# Altium schematic sheet MAZ000152 - Diagrama físico.SchDoc: MAZ000152 - Diagrama físico
size A; ApprovedBy: Christian Ledwidth; CheckedBy: Nahuel Martinez; Author: Santiago Marti; CompanyName: Body Health; DrawnBy: Santiago Marti; Revision: A; SheetNumber: 2; SheetTotal: 2
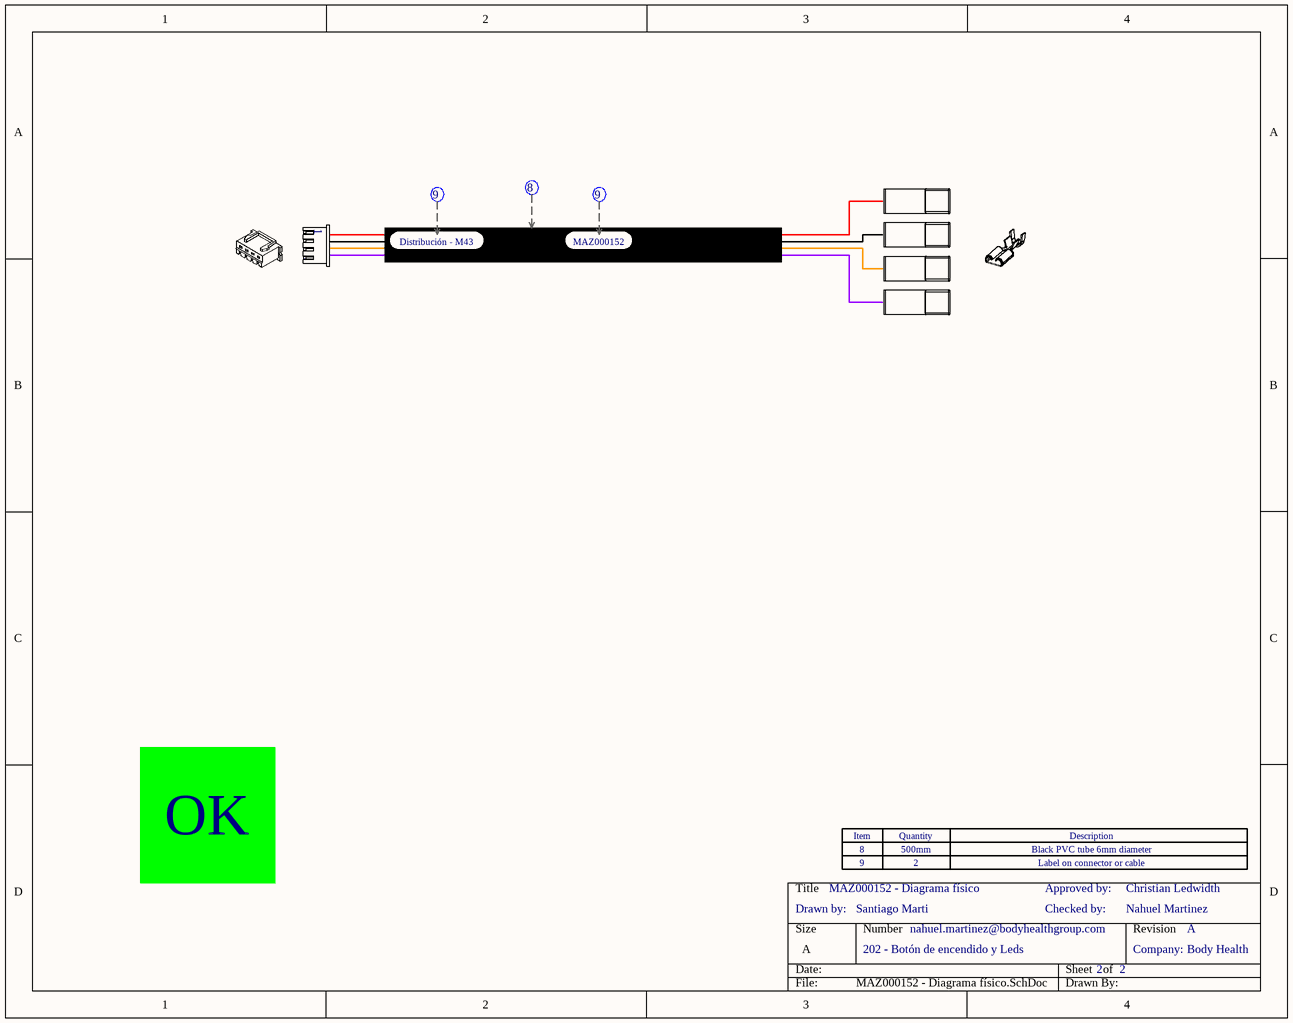
[diagram p0: MAZ000152 - Diagrama físico.SchDoc]

## Parts
(Parts that share a designator on the sheet are numbered #1, #2 ... from top to bottom, then left to right.)
Con?#1  Shovel  (value not drawn)  (part A of 4)
Con?#2  Shovel  (value not drawn)  (part A of 4)
Con?#3  XHP-4  (value not drawn)  (part A of 4)
Con?#4  Shovel  (value not drawn)  (part B of 4)
Con?#5  XHP-4  (value not drawn)  (part B of 4)
Con?#6  Shovel  (value not drawn)  (part A of 4)
Con?#7  Shovel  (value not drawn)  (part A of 4)
Eti?#1  Etiqueta  (value not drawn)
Eti?#2  Etiqueta  (value not drawn)
Ter?  Termocontraible  (value not drawn)
Zoc1  Zócalo_Header  (value not drawn)
Zoc10  Zócalo_Item  (value not drawn)
Zoc11  Zócalo_Item  (value not drawn)

## Notes on the sheet
- (near Eti?#1) Distribución - M43
- MAZ000152
- OK
- Drawn by:
- 9
- 8
- 2
- 500mm
- Checked by:
- Approved by:
- Label on connector or cable
- Black PVC tube 6mm diameter
- 202 - Botón de encendido y Leds
- nahuel.martinez@bodyhealthgroup.com
- Company:
- (in symbol Zócalo_Header) Item; Quantity; Description

## Library data of the parts
Con?#1 Con?#2 Con?#4 Con?#6 Con?#7 = Shovel: CONN HOUSING SHOVEL M4; Cod.DigiKey: -; Cod.Fabricante: -; ComponentLink1Description: Manufacturer Link; ComponentLink1URL: -; DIGIKEYx50: -; Fabricante: -; CallOut: *; DIGIKEYx100: -
Con?#3 Con?#5 = XHP-4: CONN HOUSING 2.5MM 4POS; Fabricante: JST Sales America Inc.; Cod.DigiKey: 455-2267-ND; Cod.Fabricante: XHP-4; ComponentLink1Description: Manufacturer Link; ComponentLink1URL: http://www.jst-mfg.com/product/pdf/eng/eXH.pdf; DIGIKEYx50: 0.06220; CallOut: *; DIGIKEYx100: NO
Eti?#1 Eti?#2 = Etiqueta: CallOut: 9; Texto: *
Ter? = Termocontraible: CallOut: 8; Largo: *; Diámetro: *
Zoc1 = Zócalo_Header: Header para el zócalo de referencias
Zoc10 Zoc11 = Zócalo_Item: Ítem para el zócalo de referencias; Desginator: *; Quantity: *; ItemDescription: *